# EasyEDA Pro project ProProject_IMUSensorNodes202312.epro, board 6_6_拼板20240123（不带编号） (continued)
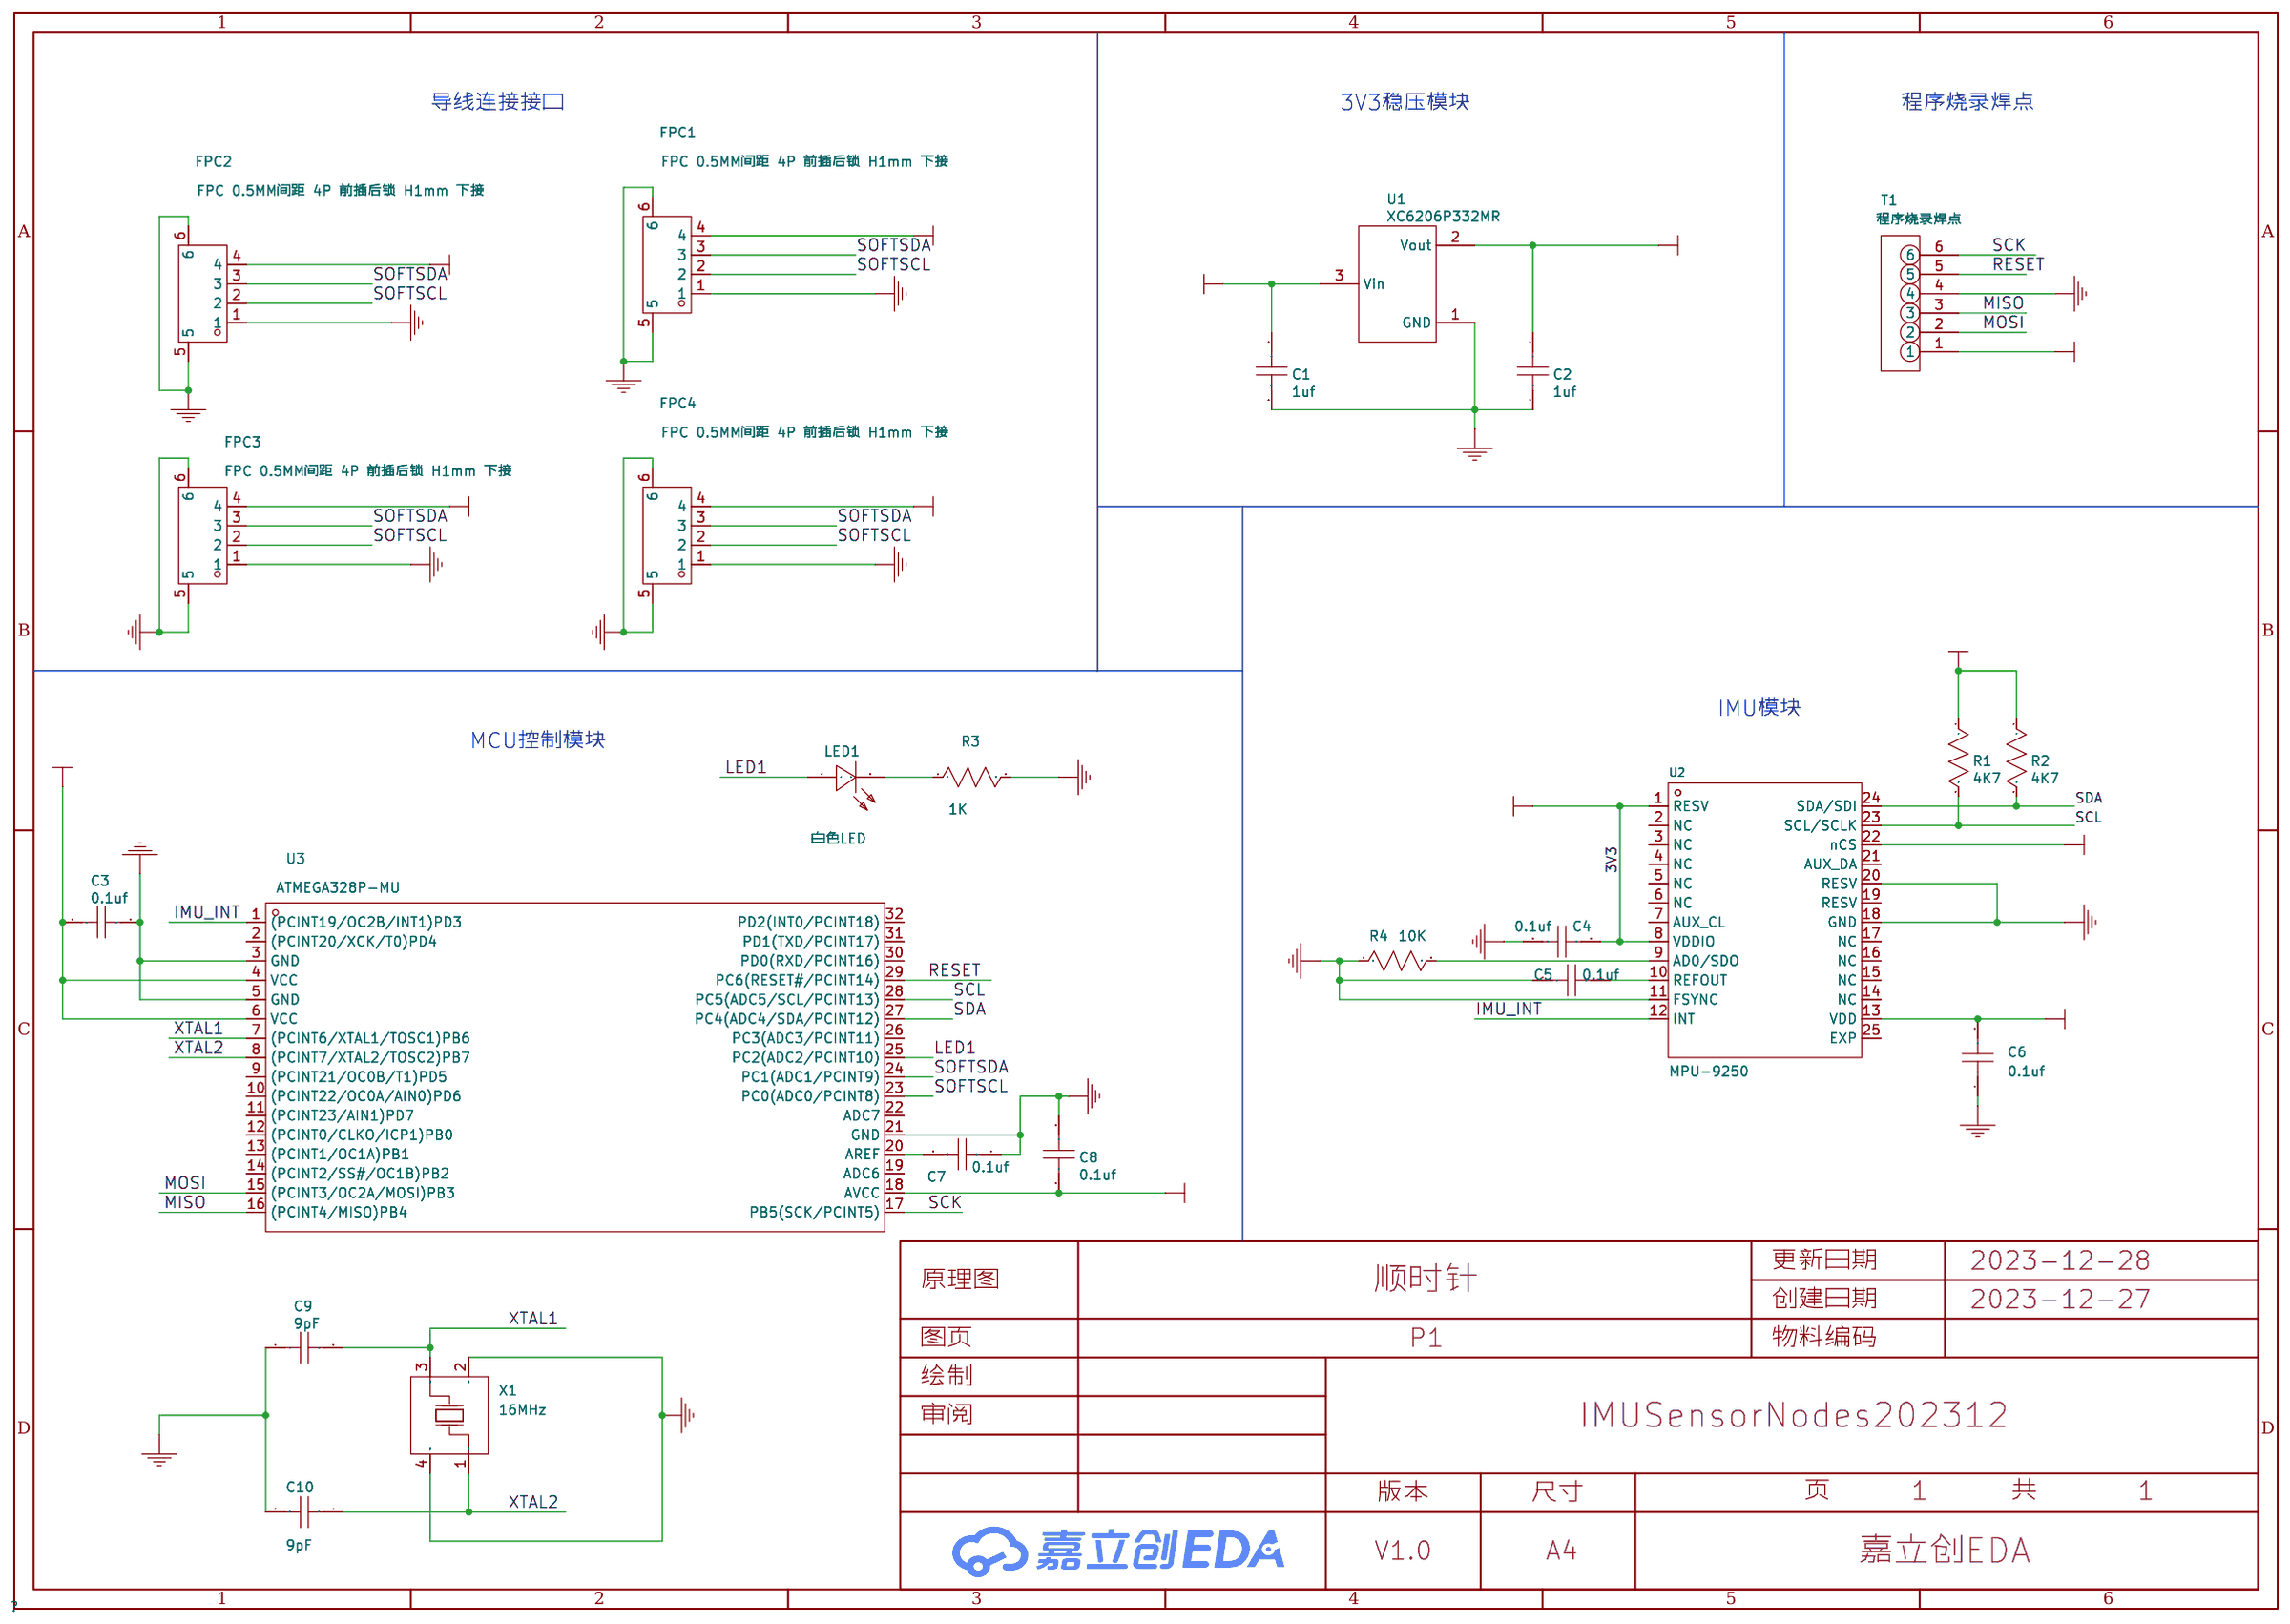
[diagram p0: schematic sheet]
## Nets (continued)
3V3: C2.1 C2#2.1 C2#3.1 C2#4.1 C2#5.1 C2#6.1 C2#7.1 C2#8.1 C2#9.1 C2#10.1 C2#11.1 C2#12.1 C2#13.1 C2#14.1 C2#15.1 C2#16.1 C2#17.1 C2#18.1 C2#19.1 C2#20.1 C2#21.1 C2#22.1 C2#23.1 C2#24.1 C2#25.1 C2#26.1 C2#27.1 C2#28.1 C2#29.1 C2#30.1 C2#31.1 C2#32.1 C2#33.1 C2#34.1 C2#35.1 C2#36.1 C3.1 C3#2.1 C3#3.1 C3#4.1 C3#5.1 C3#6.1 C3#7.1 C3#8.1 C3#9.1 C3#10.1 C3#11.1 C3#12.1 C3#13.1 C3#14.1 C3#15.1 C3#16.1 C3#17.1 C3#18.1 C3#19.1 C3#20.1 C3#21.1 C3#22.1 C3#23.1 C3#24.1 C3#25.1 C3#26.1 C3#27.1 C3#28.1 C3#29.1 C3#30.1 C3#31.1 C3#32.1 C3#33.1 C3#34.1 C3#35.1 C3#36.1 C4.1 C4#2.1 C4#3.1 C4#4.1 C4#5.1 C4#6.1 C4#7.1 C4#8.1 C4#9.1 C4#10.1 C4#11.1 C4#12.1 C4#13.1 C4#14.1 C4#15.1 C4#16.1 C4#17.1 C4#18.1 C4#19.1 C4#20.1 C4#21.1 C4#22.1 C4#23.1 C4#24.1 C4#25.1 C4#26.1 C4#27.1 C4#28.1 C4#29.1 C4#30.1 C4#31.1 C4#32.1 C4#33.1 C4#34.1 C4#35.1 C4#36.1 C6.2 C6#2.2 C6#3.2 C6#4.2 C6#5.2 C6#6.2 C6#7.2 C6#8.2 C6#9.2 C6#10.2 C6#11.2 C6#12.2 C6#13.2 C6#14.2 C6#15.2 C6#16.2 C6#17.2 C6#18.2 C6#19.2 C6#20.2 C6#21.2 C6#22.2 C6#23.2 C6#24.2 C6#25.2 C6#26.2 C6#27.2 C6#28.2 C6#29.2 C6#30.2 C6#31.2 C6#32.2 C6#33.2 C6#34.2 C6#35.2 C6#36.2 C8.1 C8#2.1 C8#3.1 C8#4.1 C8#5.1 C8#6.1 C8#7.1 C8#8.1 C8#9.1 C8#10.1 C8#11.1 C8#12.1 C8#13.1 C8#14.1 C8#15.1 C8#16.1 C8#17.1 C8#18.1 C8#19.1 C8#20.1 C8#21.1 C8#22.1 C8#23.1 C8#24.1 C8#25.1 C8#26.1 C8#27.1 C8#28.1 C8#29.1 C8#30.1 C8#31.1 C8#32.1 C8#33.1 C8#34.1 C8#35.1 C8#36.1 R1.1 R1#2.1 R1#3.1 R1#4.1 R1#5.1 R1#6.1 R1#7.1 R1#8.1 R1#9.1 R1#10.1 R1#11.1 R1#12.1 R1#13.1 R1#14.1 R1#15.1 R1#16.1 R1#17.1 R1#18.1 R1#19.1 R1#20.1 R1#21.1 R1#22.1 R1#23.1 R1#24.1 R1#25.1 R1#26.1 R1#27.1 R1#28.1 R1#29.1 R1#30.1 R1#31.1 R1#32.1 R1#33.1 R1#34.1 R1#35.1 R1#36.1 R2.1 R2#2.1 R2#3.1 R2#4.1 R2#5.1 R2#6.1 R2#7.1 R2#8.1 R2#9.1 R2#10.1 R2#11.1 R2#12.1 R2#13.1 R2#14.1 R2#15.1 R2#16.1 R2#17.1 R2#18.1 R2#19.1 R2#20.1 R2#21.1 R2#22.1 R2#23.1 R2#24.1 R2#25.1 R2#26.1 R2#27.1 R2#28.1 R2#29.1 R2#30.1 R2#31.1 R2#32.1 R2#33.1 R2#34.1 R2#35.1 R2#36.1 U1.2 U1#2.2 U1#3.2 U1#4.2 U1#5.2 U1#6.2 U1#7.2 U1#8.2 U1#9.2 U1#10.2 U1#11.2 U1#12.2 U1#13.2 U1#14.2 U1#15.2 U1#16.2 U1#17.2 U1#18.2 U1#19.2 U1#20.2 U1#21.2 U1#22.2 U1#23.2 U1#24.2 U1#25.2 U1#26.2 U1#27.2 U1#28.2 U1#29.2 U1#30.2 U1#31.2 U1#32.2 U1#33.2 U1#34.2 U1#35.2 U1#36.2 U2.1 U2.8 U2.13 U2.22 U2#2.1 U2#2.8 U2#2.13 U2#2.22 U2#3.1 U2#3.8 U2#3.13 U2#3.22 U2#4.1 U2#4.8 U2#4.13 U2#4.22 U2#5.1 U2#5.8 U2#5.13 U2#5.22 U2#6.1 U2#6.8 U2#6.13 U2#6.22 U2#7.1 U2#7.8 U2#7.13 U2#7.22 U2#8.1 U2#8.8 U2#8.13 U2#8.22 U2#9.1 U2#9.8 U2#9.13 U2#9.22 U2#10.1 U2#10.8 U2#10.13 U2#10.22 U2#11.1 U2#11.8 U2#11.13 U2#11.22 U2#12.1 U2#12.8 U2#12.13 U2#12.22 U2#13.1 U2#13.8 U2#13.13 U2#13.22 U2#14.1 U2#14.8 U2#14.13 U2#14.22 U2#15.1 U2#15.8 U2#15.13 U2#15.22 U2#16.1 U2#16.8 U2#16.13 U2#16.22 U2#17.1 U2#17.8 U2#17.13 U2#17.22 U2#18.1 U2#18.8 U2#18.13 U2#18.22 U2#19.1 U2#19.8 U2#19.13 U2#19.22 U2#20.1 U2#20.8 U2#20.13 U2#20.22 U2#21.1 U2#21.8 U2#21.13 U2#21.22 U2#22.1 U2#22.8 U2#22.13 U2#22.22 U2#23.1 U2#23.8 U2#23.13 U2#23.22 U2#24.1 U2#24.8 U2#24.13 U2#24.22 U2#25.1 U2#25.8 U2#25.13 U2#25.22 U2#26.1 U2#26.8 U2#26.13 U2#26.22 U2#27.1 U2#27.8 U2#27.13 U2#27.22 U2#28.1 U2#28.8 U2#28.13 U2#28.22 U2#29.1 U2#29.8 U2#29.13 U2#29.22 U2#30.1 U2#30.8 U2#30.13 U2#30.22 U2#31.1 U2#31.8 U2#31.13 U2#31.22 U2#32.1 U2#32.8 U2#32.13 U2#32.22 U2#33.1 U2#33.8 U2#33.13 U2#33.22 U2#34.1 U2#34.8 U2#34.13 U2#34.22 U2#35.1 U2#35.8 U2#35.13 U2#35.22 U2#36.1 U2#36.8 U2#36.13 U2#36.22 U3#61.4 U3#61.6 U3#61.18 U3#62.4 U3#62.6 U3#62.18 U3#63.4 U3#63.6 U3#63.18 U3#64.4 U3#64.6 U3#64.18 U3#65.4 U3#65.6 U3#65.18 U3#66.4 U3#66.6 U3#66.18 U3#67.4 U3#67.6 U3#67.18 U3#68.4 U3#68.6 U3#68.18 U3#69.4 U3#69.6 U3#69.18 U3#70.4 U3#70.6 U3#70.18 U3#71.4 U3#71.6 U3#71.18 U3#72.4 U3#72.6 U3#72.18 U3#73.4 U3#73.6 U3#73.18 U3#74.4 U3#74.6 U3#74.18 U3#75.4 U3#75.6 U3#75.18 U3#76.4 U3#76.6 U3#76.18 U3#77.4 U3#77.6 U3#77.18 U3#78.4 U3#78.6 U3#78.18 U3#79.4 U3#79.6 U3#79.18 U3#80.4 U3#80.6 U3#80.18 U3#81.4 U3#81.6 U3#81.18 U3#82.4 U3#82.6 U3#82.18 U3#83.4 U3#83.6 U3#83.18 U3#84.4 U3#84.6 U3#84.18 U3#85.4 U3#85.6 U3#85.18 U3#86.4 U3#86.6 U3#86.18 U3#87.4 U3#87.6 U3#87.18 U3#88.4 U3#88.6 U3#88.18 U3#89.4 U3#89.6 U3#89.18 U3#90.4 U3#90.6 U3#90.18 U3#91.4 U3#91.6 U3#91.18 U3#92.4 U3#92.6 U3#92.18 U3#93.4 U3#93.6 U3#93.18 U3#94.4 U3#94.6 U3#94.18 U3#95.4 U3#95.6 U3#95.18 U3#96.4 U3#96.6 U3#96.18
5V: C1.1 C1#2.1 C1#3.1 C1#4.1 C1#5.1 C1#6.1 C1#7.1 C1#8.1 C1#9.1 C1#10.1 C1#11.1 C1#12.1 C1#13.1 C1#14.1 C1#15.1 C1#16.1 C1#17.1 C1#18.1 C1#19.1 C1#20.1 C1#21.1 C1#22.1 C1#23.1 C1#24.1 C1#25.1 C1#26.1 C1#27.1 C1#28.1 C1#29.1 C1#30.1 C1#31.1 C1#32.1 C1#33.1 C1#34.1 C1#35.1 C1#36.1 FPC1.1 FPC1#2.1 FPC1#3.4 FPC1#4.1 FPC1#5.1 FPC1#6.1 FPC1#7.4 FPC1#8.1 FPC1#9.4 FPC1#10.4 FPC1#11.4 FPC1#12.1 FPC1#13.1 FPC1#14.1 FPC1#15.4 FPC1#16.4 FPC1#17.1 FPC1#18.1 FPC1#19.4 FPC1#20.4 FPC1#21.1 FPC1#22.4 FPC1#23.4 FPC1#24.1 FPC1#25.4 FPC1#26.4 FPC1#27.4 FPC1#28.1 FPC1#29.4 FPC1#30.4 FPC1#31.1 FPC1#32.1 FPC1#33.4 FPC1#34.1 FPC1#35.4 FPC1#36.1 FPC2.4 FPC2#2.4 FPC2#3.4 FPC2#4.1 FPC2#5.4 FPC2#6.1 FPC2#7.1 FPC2#8.1 FPC2#9.1 FPC2#10.1 FPC2#11.1 FPC2#12.1 FPC2#13.1 FPC2#14.4 FPC2#15.4 FPC2#16.4 FPC2#17.4 FPC2#18.4 FPC2#19.1 FPC2#20.4 FPC2#21.1 FPC2#22.4 FPC2#23.1 FPC2#24.4 FPC2#25.1 FPC2#26.4 FPC2#27.4 FPC2#28.4 FPC2#29.4 FPC2#30.4 FPC2#31.4 FPC2#32.1 FPC2#33.1 FPC2#34.1 FPC2#35.1 FPC2#36.1 FPC3.1 FPC3#2.4 FPC3#3.4 FPC3#4.4 FPC3#5.1 FPC3#6.1 FPC3#7.4 FPC3#8.1 FPC3#9.4 FPC3#10.1 FPC3#11.4 FPC3#12.1 FPC3#13.1 FPC3#14.1 FPC3#15.1 FPC3#16.4 FPC3#17.1 FPC3#18.4 FPC3#19.4 FPC3#20.1 FPC3#21.4 FPC3#22.4 FPC3#23.4 FPC3#24.4 FPC3#25.1 FPC3#26.1 FPC3#27.1 FPC3#28.4 FPC3#29.4 FPC3#30.1 FPC3#31.1 FPC3#32.1 FPC3#33.4 FPC3#34.4 FPC3#35.4 FPC3#36.1 FPC4.1 FPC4#2.4 FPC4#3.1 FPC4#4.4 FPC4#5.4 FPC4#6.1 FPC4#7.1 FPC4#8.1 FPC4#9.4 FPC4#10.4 FPC4#11.1 FPC4#12.1 FPC4#13.1 FPC4#14.4 FPC4#15.4 FPC4#16.4 FPC4#17.1 FPC4#18.1 FPC4#19.1 FPC4#20.4 FPC4#21.4 FPC4#22.4 FPC4#23.1 FPC4#24.4 FPC4#25.1 FPC4#26.4 FPC4#27.1 FPC4#28.4 FPC4#29.4 FPC4#30.1 FPC4#31.4 FPC4#32.4 FPC4#33.1 FPC4#34.4 FPC4#35.1 FPC4#36.1 T1.1 T1#2.1 T1#3.1 T1#4.1 T1#5.1 T1#6.1 T1#7.1 T1#8.1 T1#9.1 T1#10.1 T1#11.1 T1#12.1 T1#13.1 T1#14.1 T1#15.1 T1#16.1 T1#17.1 T1#18.1 T1#19.1 T1#20.1 T1#21.1 T1#22.1 T1#23.1 T1#24.1 T1#25.1 T1#26.1 T1#27.1 T1#28.1 T1#29.1 T1#30.1 T1#31.1 T1#32.1 T1#33.1 T1#34.1 T1#35.1 T1#36.1 U1.3 U1#2.3 U1#3.3 U1#4.3 U1#5.3 U1#6.3 U1#7.3 U1#8.3 U1#9.3 U1#10.3 U1#11.3 U1#12.3 U1#13.3 U1#14.3 U1#15.3 U1#16.3 U1#17.3 U1#18.3 U1#19.3 U1#20.3 U1#21.3 U1#22.3 U1#23.3 U1#24.3 U1#25.3 U1#26.3 U1#27.3 U1#28.3 U1#29.3 U1#30.3 U1#31.3 U1#32.3 U1#33.3 U1#34.3 U1#35.3 U1#36.3
GND: C1.2 C1#2.2 C1#3.2 C1#4.2 C1#5.2 C1#6.2 C1#7.2 C1#8.2 C1#9.2 C1#10.2 C1#11.2 C1#12.2 C1#13.2 C1#14.2 C1#15.2 C1#16.2 C1#17.2 C1#18.2 C1#19.2 C1#20.2 C1#21.2 C1#22.2 C1#23.2 C1#24.2 C1#25.2 C1#26.2 C1#27.2 C1#28.2 C1#29.2 C1#30.2 C1#31.2 C1#32.2 C1#33.2 C1#34.2 C1#35.2 C1#36.2 C2.2 C2#2.2 C2#3.2 C2#4.2 C2#5.2 C2#6.2 C2#7.2 C2#8.2 C2#9.2 C2#10.2 C2#11.2 C2#12.2 C2#13.2 C2#14.2 C2#15.2 C2#16.2 C2#17.2 C2#18.2 C2#19.2 C2#20.2 C2#21.2 C2#22.2 C2#23.2 C2#24.2 C2#25.2 C2#26.2 C2#27.2 C2#28.2 C2#29.2 C2#30.2 C2#31.2 C2#32.2 C2#33.2 C2#34.2 C2#35.2 C2#36.2 C3.2 C3#2.2 C3#3.2 C3#4.2 C3#5.2 C3#6.2 C3#7.2 C3#8.2 C3#9.2 C3#10.2 C3#11.2 C3#12.2 C3#13.2 C3#14.2 C3#15.2 C3#16.2 C3#17.2 C3#18.2 C3#19.2 C3#20.2 C3#21.2 C3#22.2 C3#23.2 C3#24.2 C3#25.2 C3#26.2 C3#27.2 C3#28.2 C3#29.2 C3#30.2 C3#31.2 C3#32.2 C3#33.2 C3#34.2 C3#35.2 C3#36.2 C4.2 C4#2.2 C4#3.2 C4#4.2 C4#5.2 C4#6.2 C4#7.2 C4#8.2 C4#9.2 C4#10.2 C4#11.2 C4#12.2 C4#13.2 C4#14.2 C4#15.2 C4#16.2 C4#17.2 C4#18.2 C4#19.2 C4#20.2 C4#21.2 C4#22.2 C4#23.2 C4#24.2 C4#25.2 C4#26.2 C4#27.2 C4#28.2 C4#29.2 C4#30.2 C4#31.2 C4#32.2 C4#33.2 C4#34.2 C4#35.2 C4#36.2 C5.1 C5#2.1 C5#3.1 C5#4.1 C5#5.1 C5#6.1 C5#7.1 C5#8.1 C5#9.1 C5#10.1 C5#11.1 C5#12.1 C5#13.1 C5#14.1 C5#15.1 C5#16.1 C5#17.1 C5#18.1 C5#19.1 C5#20.1 C5#21.1 C5#22.1 C5#23.1 C5#24.1 C5#25.1 C5#26.1 C5#27.1 C5#28.1 C5#29.1 C5#30.1 C5#31.1 C5#32.1 C5#33.1 C5#34.1 C5#35.1 C5#36.1 C6.1 C6#2.1 C6#3.1 C6#4.1 C6#5.1 C6#6.1 C6#7.1 C6#8.1 C6#9.1 C6#10.1 C6#11.1 C6#12.1 C6#13.1 C6#14.1 C6#15.1 C6#16.1 C6#17.1 C6#18.1 C6#19.1 C6#20.1 C6#21.1 C6#22.1 C6#23.1 C6#24.1 C6#25.1 C6#26.1 C6#27.1 C6#28.1 C6#29.1 C6#30.1 C6#31.1 C6#32.1 C6#33.1 C6#34.1 C6#35.1 C6#36.1 C7.1 C7#2.1 C7#3.1 C7#4.1 C7#5.1 C7#6.1 C7#7.1 C7#8.1 C7#9.1 C7#10.1 C7#11.1 C7#12.1 C7#13.1 C7#14.1 C7#15.1 C7#16.1 C7#17.1 C7#18.1 C7#19.1 C7#20.1 C7#21.1 C7#22.1 C7#23.1 C7#24.1 C7#25.1 C7#26.1 C7#27.1 C7#28.1 C7#29.1 C7#30.1 C7#31.1 C7#32.1 C7#33.1 C7#34.1 C7#35.1 C7#36.1 C8.2 C8#2.2 C8#3.2 C8#4.2 C8#5.2 C8#6.2 C8#7.2 C8#8.2 C8#9.2 C8#10.2 C8#11.2 C8#12.2 C8#13.2 C8#14.2 C8#15.2 C8#16.2 C8#17.2 C8#18.2 C8#19.2 C8#20.2 C8#21.2 C8#22.2 C8#23.2 C8#24.2 C8#25.2 C8#26.2 C8#27.2 C8#28.2 C8#29.2 C8#30.2 C8#31.2 C8#32.2 C8#33.2 C8#34.2 C8#35.2 C8#36.2 C9.1 C9#2.1 C9#3.1 C9#4.1 C9#5.1 C9#6.1 C9#7.1 C9#8.1 C9#9.1 C9#10.1 C9#11.1 C9#12.1 C9#13.1 C9#14.1 C9#15.1 C9#16.1 C9#17.1 C9#18.1 C9#19.1 C9#20.1 C9#21.1 C9#22.1 C9#23.1 C9#24.1 C9#25.1 C9#26.1 C9#27.1 C9#28.1 C9#29.1 C9#30.1 C9#31.1 C9#32.1 C9#33.1 C9#34.1 C9#35.1 C9#36.1 C10.2 C10#2.2 C10#3.2 C10#4.2 C10#5.2 C10#6.2 C10#7.2 C10#8.2 C10#9.2 C10#10.2 C10#11.2 C10#12.2 C10#13.2 C10#14.2 C10#15.2 C10#16.2 C10#17.2 C10#18.2 C10#19.2 C10#20.2 C10#21.2 C10#22.2 C10#23.2 C10#24.2 C10#25.2 C10#26.2 C10#27.2 C10#28.2 C10#29.2 C10#30.2 C10#31.2 C10#32.2 C10#33.2 C10#34.2 C10#35.2 C10#36.2 FPC1.4 FPC1.5 FPC1.6 FPC1#2.4 FPC1#2.5 FPC1#2.6 FPC1#3.1 FPC1#3.5 FPC1#3.6 FPC1#4.4 FPC1#4.5 FPC1#4.6 FPC1#5.4 FPC1#5.5 FPC1#5.6 FPC1#6.4 FPC1#6.5 FPC1#6.6 FPC1#7.1 FPC1#7.5 FPC1#7.6 FPC1#8.4 FPC1#8.5 FPC1#8.6 FPC1#9.1 FPC1#9.5 FPC1#9.6 FPC1#10.1 FPC1#10.5 FPC1#10.6 FPC1#11.1 FPC1#11.5 FPC1#11.6 FPC1#12.4 FPC1#12.5 FPC1#12.6 FPC1#13.4 FPC1#13.5 FPC1#13.6 FPC1#14.4 FPC1#14.5 FPC1#14.6 FPC1#15.1 FPC1#15.5 FPC1#15.6 FPC1#16.1 FPC1#16.5 FPC1#16.6 FPC1#17.4 FPC1#17.5 FPC1#17.6 FPC1#18.4 FPC1#18.5 FPC1#18.6 FPC1#19.1 FPC1#19.5 FPC1#19.6 FPC1#20.1 FPC1#20.5 FPC1#20.6 FPC1#21.4 FPC1#21.5 FPC1#21.6 FPC1#22.1 FPC1#22.5 FPC1#22.6 FPC1#23.1 FPC1#23.5 FPC1#23.6 FPC1#24.4 FPC1#24.5 FPC1#24.6 FPC1#25.1 FPC1#25.5 FPC1#25.6 FPC1#26.1 FPC1#26.5 FPC1#26.6 FPC1#27.1 FPC1#27.5 FPC1#27.6 FPC1#28.4 FPC1#28.5 FPC1#28.6 FPC1#29.1 FPC1#29.5 FPC1#29.6 FPC1#30.1 FPC1#30.5 FPC1#30.6 FPC1#31.4 FPC1#31.5 FPC1#31.6 FPC1#32.4 FPC1#32.5 FPC1#32.6 FPC1#33.1 FPC1#33.5 FPC1#33.6 FPC1#34.4 FPC1#34.5 FPC1#34.6 FPC1#35.1 FPC1#35.5 FPC1#35.6 FPC1#36.4 FPC1#36.5 FPC1#36.6 FPC2.1 FPC2.5 FPC2.6 FPC2#2.1 FPC2#2.5 FPC2#2.6 FPC2#3.1 FPC2#3.5 FPC2#3.6 FPC2#4.4 FPC2#4.5 FPC2#4.6 FPC2#5.1 FPC2#5.5 FPC2#5.6 FPC2#6.4 FPC2#6.5 FPC2#6.6 FPC2#7.4 FPC2#7.5 FPC2#7.6 FPC2#8.4 FPC2#8.5 FPC2#8.6 FPC2#9.4 FPC2#9.5 FPC2#9.6 FPC2#10.4 FPC2#10.5 FPC2#10.6 FPC2#11.4 FPC2#11.5 FPC2#11.6 FPC2#12.4 FPC2#12.5 FPC2#12.6 FPC2#13.4 FPC2#13.5 FPC2#13.6 FPC2#14.1 FPC2#14.5 FPC2#14.6 FPC2#15.1 FPC2#15.5 FPC2#15.6 FPC2#16.1 FPC2#16.5 FPC2#16.6 FPC2#17.1 FPC2#17.5 FPC2#17.6 FPC2#18.1 FPC2#18.5 FPC2#18.6 FPC2#19.4 FPC2#19.5 FPC2#19.6 FPC2#20.1 FPC2#20.5 FPC2#20.6 FPC2#21.4 FPC2#21.5 FPC2#21.6 FPC2#22.1 FPC2#22.5 FPC2#22.6 FPC2#23.4 FPC2#23.5 FPC2#23.6 FPC2#24.1 FPC2#24.5 FPC2#24.6 FPC2#25.4 FPC2#25.5 FPC2#25.6 FPC2#26.1 FPC2#26.5 FPC2#26.6 FPC2#27.1 FPC2#27.5 FPC2#27.6 FPC2#28.1 FPC2#28.5 FPC2#28.6 FPC2#29.1 FPC2#29.5 FPC2#29.6 FPC2#30.1 FPC2#30.5 FPC2#30.6 FPC2#31.1 FPC2#31.5 FPC2#31.6 FPC2#32.4 FPC2#32.5 FPC2#32.6 FPC2#33.4 FPC2#33.5 FPC2#33.6 FPC2#34.4 FPC2#34.5 FPC2#34.6 FPC2#35.4 FPC2#35.5 FPC2#35.6 FPC2#36.4 FPC2#36.5 FPC2#36.6 FPC3.4 FPC3.5 FPC3.6 FPC3#2.1 FPC3#2.5 FPC3#2.6 FPC3#3.1 FPC3#3.5 FPC3#3.6 FPC3#4.1 FPC3#4.5 FPC3#4.6 FPC3#5.4 FPC3#5.5 FPC3#5.6 FPC3#6.4 FPC3#6.5 FPC3#6.6 FPC3#7.1 FPC3#7.5 FPC3#7.6 FPC3#8.4 FPC3#8.5 FPC3#8.6 FPC3#9.1 FPC3#9.5 FPC3#9.6 FPC3#10.4 FPC3#10.5 FPC3#10.6 FPC3#11.1 FPC3#11.5 FPC3#11.6 FPC3#12.4 FPC3#12.5 FPC3#12.6 FPC3#13.4 FPC3#13.5 FPC3#13.6 FPC3#14.4 FPC3#14.5 FPC3#14.6 FPC3#15.4 FPC3#15.5 FPC3#15.6 FPC3#16.1 FPC3#16.5 FPC3#16.6 FPC3#17.4 FPC3#17.5 FPC3#17.6 FPC3#18.1 FPC3#18.5 FPC3#18.6 FPC3#19.1 FPC3#19.5 FPC3#19.6 FPC3#20.4 FPC3#20.5 FPC3#20.6 FPC3#21.1 FPC3#21.5 FPC3#21.6 FPC3#22.1 FPC3#22.5 FPC3#22.6 FPC3#23.1 FPC3#23.5 FPC3#23.6 FPC3#24.1 FPC3#24.5 FPC3#24.6 FPC3#25.4 FPC3#25.5 FPC3#25.6 FPC3#26.4 FPC3#26.5 FPC3#26.6 FPC3#27.4 FPC3#27.5 FPC3#27.6 FPC3#28.1 FPC3#28.5 FPC3#28.6 FPC3#29.1 FPC3#29.5 FPC3#29.6 FPC3#30.4 FPC3#30.5 FPC3#30.6 FPC3#31.4 FPC3#31.5 FPC3#31.6 FPC3#32.4 FPC3#32.5 FPC3#32.6 FPC3#33.1 FPC3#33.5 FPC3#33.6 FPC3#34.1 FPC3#34.5 FPC3#34.6 FPC3#35.1 FPC3#35.5 FPC3#35.6 FPC3#36.4 FPC3#36.5 FPC3#36.6 FPC4.4 FPC4#2.1 FPC4#3.4 FPC4#4.1 FPC4#5.1 FPC4#6.4 FPC4#7.4 FPC4#8.4 FPC4#9.1 FPC4#10.1 FPC4#11.4 FPC4#12.4 FPC4#13.4 FPC4#14.1 FPC4#15.1 FPC4#16.1 FPC4#17.4 FPC4#18.4 FPC4#19.4 FPC4#20.1 FPC4#21.1 FPC4#22.1 FPC4#23.4 FPC4#24.1 FPC4#25.4 FPC4#26.1 FPC4#27.4 FPC4#28.1 FPC4#29.1 FPC4#30.4 FPC4#31.1 FPC4#32.1 FPC4#33.4 FPC4#34.1 FPC4#35.4 FPC4#36.4 R3.2 R3#2.2 R3#3.2 R3#4.2 R3#5.2 R3#6.2 R3#7.2 R3#8.2 R3#9.2 R3#10.2 R3#11.2 R3#12.2 R3#13.2 R3#14.2 R3#15.2 R3#16.2 R3#17.2 R3#18.2 R3#19.2 R3#20.2 R3#21.2 R3#22.2 R3#23.2 R3#24.2 R3#25.2 R3#26.2 R3#27.2 R3#28.2 R3#29.2 R3#30.2 R3#31.2 R3#32.2 R3#33.2 R3#34.2 R3#35.2 R3#36.2 R4.1 R4#2.1 R4#3.1 R4#4.1 R4#5.1 R4#6.1 R4#7.1 R4#8.1 R4#9.1 R4#10.1 R4#11.1 R4#12.1 R4#13.1 R4#14.1 R4#15.1 R4#16.1 R4#17.1 R4#18.1 R4#19.1 R4#20.1 R4#21.1 R4#22.1 R4#23.1 R4#24.1 R4#25.1 R4#26.1 R4#27.1 R4#28.1 R4#29.1 R4#30.1 R4#31.1 R4#32.1 R4#33.1 R4#34.1 R4#35.1 R4#36.1 T1.4 T1#2.4 T1#3.4 T1#4.4 T1#5.4 T1#6.4 T1#7.4 T1#8.4 T1#9.4 T1#10.4 T1#11.4 T1#12.4 T1#13.4 T1#14.4 T1#15.4 T1#16.4 T1#17.4 T1#18.4 T1#19.4 T1#20.4 T1#21.4 T1#22.4 T1#23.4 T1#24.4 T1#25.4 T1#26.4 T1#27.4 T1#28.4 T1#29.4 T1#30.4 T1#31.4 T1#32.4 T1#33.4 T1#34.4 T1#35.4 T1#36.4 U1.1 U1#2.1 U1#3.1 U1#4.1 U1#5.1 U1#6.1 U1#7.1 U1#8.1 U1#9.1 U1#10.1 U1#11.1 U1#12.1 U1#13.1 U1#14.1 U1#15.1 U1#16.1 U1#17.1 U1#18.1 U1#19.1 U1#20.1 U1#21.1 U1#22.1 U1#23.1 U1#24.1 U1#25.1 U1#26.1 U1#27.1 U1#28.1 U1#29.1 U1#30.1 U1#31.1 U1#32.1 U1#33.1 U1#34.1 U1#35.1 U1#36.1 U2.11 U2.18 U2.20 U2.25 U2#2.11 U2#2.18 U2#2.20 U2#2.25 U2#3.11 U2#3.18 U2#3.20 U2#3.25 U2#4.11 U2#4.18 U2#4.20 U2#4.25 U2#5.11 U2#5.18 U2#5.20 U2#5.25 U2#6.11 U2#6.18 U2#6.20 U2#6.25 U2#7.11 U2#7.18 U2#7.20 U2#7.25 U2#8.11 U2#8.18 U2#8.20 U2#8.25 U2#9.11 U2#9.18 U2#9.20 U2#9.25 U2#10.11 U2#10.18 U2#10.20 U2#10.25 U2#11.11 U2#11.18 U2#11.20 U2#11.25 U2#12.11 U2#12.18 U2#12.20 U2#12.25 U2#13.11 U2#13.18 U2#13.20 U2#13.25 U2#14.11 U2#14.18 U2#14.20 U2#14.25 U2#15.11 U2#15.18 U2#15.20 U2#15.25 U2#16.11 U2#16.18 U2#16.20 U2#16.25 U2#17.11 U2#17.18 U2#17.20 U2#17.25 U2#18.11 U2#18.18 U2#18.20 U2#18.25 U2#19.11 U2#19.18 U2#19.20 U2#19.25 U2#20.11 U2#20.18 U2#20.20 U2#20.25 U2#21.11 U2#21.18 U2#21.20 U2#21.25 U2#22.11 U2#22.18 U2#22.20 U2#22.25 U2#23.11 U2#23.18 U2#23.20 U2#23.25 U2#24.11 U2#24.18 U2#24.20 U2#24.25 U2#25.11 U2#25.18 U2#25.20 U2#25.25 U2#26.11 U2#26.18 U2#26.20 U2#26.25 U2#27.11 U2#27.18 U2#27.20 U2#27.25 U2#28.11 U2#28.18 U2#28.20 U2#28.25 U2#29.11 U2#29.18 U2#29.20 U2#29.25 U2#30.11 U2#30.18 U2#30.20 U2#30.25 U2#31.11 U2#31.18 U2#31.20 U2#31.25 U2#32.11 U2#32.18 U2#32.20 U2#32.25 U2#33.11 U2#33.18 U2#33.20 U2#33.25 U2#34.11 U2#34.18 U2#34.20 U2#34.25 U2#35.11 U2#35.18 U2#35.20 U2#35.25 U2#36.11 U2#36.18 U2#36.20 U2#36.25 U3#61.3 U3#61.5 U3#61.21 U3#61.33 U3#62.3 U3#62.5 U3#62.21 U3#62.33 U3#63.3 U3#63.5 U3#63.21 U3#63.33 U3#64.3 U3#64.5 U3#64.21 U3#64.33 U3#65.3 U3#65.5 U3#65.21 U3#65.33 U3#66.3 U3#66.5 U3#66.21 U3#66.33 U3#67.3 U3#67.5 U3#67.21 U3#67.33 U3#68.3 U3#68.5 U3#68.21 U3#68.33 U3#69.3 U3#69.5 U3#69.21 U3#69.33 U3#70.3 U3#70.5 U3#70.21 U3#70.33 U3#71.3 U3#71.5 U3#71.21 U3#71.33 U3#72.3 U3#72.5 U3#72.21 U3#72.33 U3#73.3 U3#73.5 U3#73.21 U3#73.33 U3#74.3 U3#74.5 U3#74.21 U3#74.33 U3#75.3 U3#75.5 U3#75.21 U3#75.33 U3#76.3 U3#76.5 U3#76.21 U3#76.33 U3#77.3 U3#77.5 U3#77.21 U3#77.33 U3#78.3 U3#78.5 U3#78.21 U3#78.33 U3#79.3 U3#79.5 U3#79.21 U3#79.33 U3#80.3 U3#80.5 U3#80.21 U3#80.33 U3#81.3 U3#81.5 U3#81.21 U3#81.33 U3#82.3 U3#82.5 U3#82.21 U3#82.33 U3#83.3 U3#83.5 U3#83.21 U3#83.33 U3#84.3 U3#84.5 U3#84.21 U3#84.33 U3#85.3 U3#85.5 U3#85.21 U3#85.33 U3#86.3 U3#86.5 U3#86.21 U3#86.33 U3#87.3 U3#87.5 U3#87.21 U3#87.33 U3#88.3 U3#88.5 U3#88.21 U3#88.33 U3#89.3 U3#89.5 U3#89.21 U3#89.33 U3#90.3 U3#90.5 U3#90.21 U3#90.33 U3#91.3 U3#91.5 U3#91.21 U3#91.33 U3#92.3 U3#92.5 U3#92.21 U3#92.33 U3#93.3 U3#93.5 U3#93.21 U3#93.33 U3#94.3 U3#94.5 U3#94.21 U3#94.33 U3#95.3 U3#95.5 U3#95.21 U3#95.33 U3#96.3 U3#96.5 U3#96.21 U3#96.33 X1.2 X1.4 X1#2.2 X1#2.4 X1#3.2 X1#3.4 X1#4.2 X1#4.4 X1#5.2 X1#5.4 X1#6.2 X1#6.4 X1#7.2 X1#7.4 X1#8.2 X1#8.4 X1#9.2 X1#9.4 X1#10.2 X1#10.4 X1#11.2 X1#11.4 X1#12.2 X1#12.4 X1#13.2 X1#13.4 X1#14.2 X1#14.4 X1#15.2 X1#15.4 X1#16.2 X1#16.4 X1#17.2 X1#17.4 X1#18.2 X1#18.4 X1#19.2 X1#19.4 X1#20.2 X1#20.4 X1#21.2 X1#21.4 X1#22.2 X1#22.4 X1#23.2 X1#23.4 X1#24.2 X1#24.4 X1#25.2 X1#25.4 X1#26.2 X1#26.4 X1#27.2 X1#27.4 X1#28.2 X1#28.4 X1#29.2 X1#29.4 X1#30.2 X1#30.4 X1#31.2 X1#31.4 X1#32.2 X1#32.4 X1#33.2 X1#33.4 X1#34.2 X1#34.4 X1#35.2 X1#35.4 X1#36.2 X1#36.4
IMU_INT: U2.12 U2#2.12 U2#3.12 U2#4.12 U2#5.12 U2#6.12 U2#7.12 U2#8.12 U2#9.12 U2#10.12 U2#11.12 U2#12.12 U2#13.12 U2#14.12 U2#15.12 U2#16.12 U2#17.12 U2#18.12 U2#19.12 U2#20.12 U2#21.12 U2#22.12 U2#23.12 U2#24.12 U2#25.12 U2#26.12 U2#27.12 U2#28.12 U2#29.12 U2#30.12 U2#31.12 U2#32.12 U2#33.12 U2#34.12 U2#35.12 U2#36.12 U3#61.1 U3#62.1 U3#63.1 U3#64.1 U3#65.1 U3#66.1 U3#67.1 U3#68.1 U3#69.1 U3#70.1 U3#71.1 U3#72.1 U3#73.1 U3#74.1 U3#75.1 U3#76.1 U3#77.1 U3#78.1 U3#79.1 U3#80.1 U3#81.1 U3#82.1 U3#83.1 U3#84.1 U3#85.1 U3#86.1 U3#87.1 U3#88.1 U3#89.1 U3#90.1 U3#91.1 U3#92.1 U3#93.1 U3#94.1 U3#95.1 U3#96.1
LED1: LED1.1 LED1#2.1 LED1#3.1 LED1#4.1 LED1#5.1 LED1#6.1 LED1#7.1 LED1#8.1 LED1#9.1 LED1#10.1 LED1#11.1 LED1#12.1 LED1#13.1 LED1#14.1 LED1#15.1 LED1#16.1 LED1#17.1 LED1#18.1 LED1#19.1 LED1#20.1 LED1#21.1 LED1#22.1 LED1#23.1 LED1#24.1 LED1#25.1 LED1#26.1 LED1#27.1 LED1#28.1 LED1#29.1 LED1#30.1 LED1#31.1 LED1#32.1 LED1#33.1 LED1#34.1 LED1#35.1 LED1#36.1 U3#61.25 U3#62.25 U3#63.25 U3#64.25 U3#65.25 U3#66.25 U3#67.25 U3#68.25 U3#69.25 U3#70.25 U3#71.25 U3#72.25 U3#73.25 U3#74.25 U3#75.25 U3#76.25 U3#77.25 U3#78.25 U3#79.25 U3#80.25 U3#81.25 U3#82.25 U3#83.25 U3#84.25 U3#85.25 U3#86.25 U3#87.25 U3#88.25 U3#89.25 U3#90.25 U3#91.25 U3#92.25 U3#93.25 U3#94.25 U3#95.25 U3#96.25
MISO: T1.3 T1#2.3 T1#3.3 T1#4.3 T1#5.3 T1#6.3 T1#7.3 T1#8.3 T1#9.3 T1#10.3 T1#11.3 T1#12.3 T1#13.3 T1#14.3 T1#15.3 T1#16.3 T1#17.3 T1#18.3 T1#19.3 T1#20.3 T1#21.3 T1#22.3 T1#23.3 T1#24.3 T1#25.3 T1#26.3 T1#27.3 T1#28.3 T1#29.3 T1#30.3 T1#31.3 T1#32.3 T1#33.3 T1#34.3 T1#35.3 T1#36.3 U3#61.16 U3#62.16 U3#63.16 U3#64.16 U3#65.16 U3#66.16 U3#67.16 U3#68.16 U3#69.16 U3#70.16 U3#71.16 U3#72.16 U3#73.16 U3#74.16 U3#75.16 U3#76.16 U3#77.16 U3#78.16 U3#79.16 U3#80.16 U3#81.16 U3#82.16 U3#83.16 U3#84.16 U3#85.16 U3#86.16 U3#87.16 U3#88.16 U3#89.16 U3#90.16 U3#91.16 U3#92.16 U3#93.16 U3#94.16 U3#95.16 U3#96.16
MOSI: T1.2 T1#2.2 T1#3.2 T1#4.2 T1#5.2 T1#6.2 T1#7.2 T1#8.2 T1#9.2 T1#10.2 T1#11.2 T1#12.2 T1#13.2 T1#14.2 T1#15.2 T1#16.2 T1#17.2 T1#18.2 T1#19.2 T1#20.2 T1#21.2 T1#22.2 T1#23.2 T1#24.2 T1#25.2 T1#26.2 T1#27.2 T1#28.2 T1#29.2 T1#30.2 T1#31.2 T1#32.2 T1#33.2 T1#34.2 T1#35.2 T1#36.2 U3#61.15 U3#62.15 U3#63.15 U3#64.15 U3#65.15 U3#66.15 U3#67.15 U3#68.15 U3#69.15 U3#70.15 U3#71.15 U3#72.15 U3#73.15 U3#74.15 U3#75.15 U3#76.15 U3#77.15 U3#78.15 U3#79.15 U3#80.15 U3#81.15 U3#82.15 U3#83.15 U3#84.15 U3#85.15 U3#86.15 U3#87.15 U3#88.15 U3#89.15 U3#90.15 U3#91.15 U3#92.15 U3#93.15 U3#94.15 U3#95.15 U3#96.15
RESET: FPC4.5 FPC4.6 FPC4#2.5 FPC4#2.6 FPC4#3.5 FPC4#3.6 FPC4#4.5 FPC4#4.6 FPC4#5.5 FPC4#5.6 FPC4#6.5 FPC4#6.6 FPC4#7.5 FPC4#7.6 FPC4#8.5 FPC4#8.6 FPC4#9.5 FPC4#9.6 FPC4#10.5 FPC4#10.6 FPC4#11.5 FPC4#11.6 FPC4#12.5 FPC4#12.6 FPC4#13.5 FPC4#13.6 FPC4#14.5 FPC4#14.6 FPC4#15.5 FPC4#15.6 FPC4#16.5 FPC4#16.6 FPC4#17.5 FPC4#17.6 FPC4#18.5 FPC4#18.6 FPC4#19.5 FPC4#19.6 FPC4#20.5 FPC4#20.6 FPC4#21.5 FPC4#21.6 FPC4#22.5 FPC4#22.6 FPC4#23.5 FPC4#23.6 FPC4#24.5 FPC4#24.6 FPC4#25.5 FPC4#25.6 FPC4#26.5 FPC4#26.6 FPC4#27.5 FPC4#27.6 FPC4#28.5 FPC4#28.6 FPC4#29.5 FPC4#29.6 FPC4#30.5 FPC4#30.6 FPC4#31.5 FPC4#31.6 FPC4#32.5 FPC4#32.6 FPC4#33.5 FPC4#33.6 FPC4#34.5 FPC4#34.6 FPC4#35.5 FPC4#35.6 FPC4#36.5 FPC4#36.6 T1.5 T1#2.5 T1#3.5 T1#4.5 T1#5.5 T1#6.5 T1#7.5 T1#8.5 T1#9.5 T1#10.5 T1#11.5 T1#12.5 T1#13.5 T1#14.5 T1#15.5 T1#16.5 T1#17.5 T1#18.5 T1#19.5 T1#20.5 T1#21.5 T1#22.5 T1#23.5 T1#24.5 T1#25.5 T1#26.5 T1#27.5 T1#28.5 T1#29.5 T1#30.5 T1#31.5 T1#32.5 T1#33.5 T1#34.5 T1#35.5 T1#36.5 U3#61.29 U3#62.29 U3#63.29 U3#64.29 U3#65.29 U3#66.29 U3#67.29 U3#68.29 U3#69.29 U3#70.29 U3#71.29 U3#72.29 U3#73.29 U3#74.29 U3#75.29 U3#76.29 U3#77.29 U3#78.29 U3#79.29 U3#80.29 U3#81.29 U3#82.29 U3#83.29 U3#84.29 U3#85.29 U3#86.29 U3#87.29 U3#88.29 U3#89.29 U3#90.29 U3#91.29 U3#92.29 U3#93.29 U3#94.29 U3#95.29 U3#96.29
SCK: T1.6 T1#2.6 T1#3.6 T1#4.6 T1#5.6 T1#6.6 T1#7.6 T1#8.6 T1#9.6 T1#10.6 T1#11.6 T1#12.6 T1#13.6 T1#14.6 T1#15.6 T1#16.6 T1#17.6 T1#18.6 T1#19.6 T1#20.6 T1#21.6 T1#22.6 T1#23.6 T1#24.6 T1#25.6 T1#26.6 T1#27.6 T1#28.6 T1#29.6 T1#30.6 T1#31.6 T1#32.6 T1#33.6 T1#34.6 T1#35.6 T1#36.6 U3#61.17 U3#62.17 U3#63.17 U3#64.17 U3#65.17 U3#66.17 U3#67.17 U3#68.17 U3#69.17 U3#70.17 U3#71.17 U3#72.17 U3#73.17 U3#74.17 U3#75.17 U3#76.17 U3#77.17 U3#78.17 U3#79.17 U3#80.17 U3#81.17 U3#82.17 U3#83.17 U3#84.17 U3#85.17 U3#86.17 U3#87.17 U3#88.17 U3#89.17 U3#90.17 U3#91.17 U3#92.17 U3#93.17 U3#94.17 U3#95.17 U3#96.17
SCL: R1.2 R1#2.2 R1#3.2 R1#4.2 R1#5.2 R1#6.2 R1#7.2 R1#8.2 R1#9.2 R1#10.2 R1#11.2 R1#12.2 R1#13.2 R1#14.2 R1#15.2 R1#16.2 R1#17.2 R1#18.2 R1#19.2 R1#20.2 R1#21.2 R1#22.2 R1#23.2 R1#24.2 R1#25.2 R1#26.2 R1#27.2 R1#28.2 R1#29.2 R1#30.2 R1#31.2 R1#32.2 R1#33.2 R1#34.2 R1#35.2 R1#36.2 U2.23 U2#2.23 U2#3.23 U2#4.23 U2#5.23 U2#6.23 U2#7.23 U2#8.23 U2#9.23 U2#10.23 U2#11.23 U2#12.23 U2#13.23 U2#14.23 U2#15.23 U2#16.23 U2#17.23 U2#18.23 U2#19.23 U2#20.23 U2#21.23 U2#22.23 U2#23.23 U2#24.23 U2#25.23 U2#26.23 U2#27.23 U2#28.23 U2#29.23 U2#30.23 U2#31.23 U2#32.23 U2#33.23 U2#34.23 U2#35.23 U2#36.23 U3#61.28 U3#62.28 U3#63.28 U3#64.28 U3#65.28 U3#66.28 U3#67.28 U3#68.28 U3#69.28 U3#70.28 U3#71.28 U3#72.28 U3#73.28 U3#74.28 U3#75.28 U3#76.28 U3#77.28 U3#78.28 U3#79.28 U3#80.28 U3#81.28 U3#82.28 U3#83.28 U3#84.28 U3#85.28 U3#86.28 U3#87.28 U3#88.28 U3#89.28 U3#90.28 U3#91.28 U3#92.28 U3#93.28 U3#94.28 U3#95.28 U3#96.28
SDA: R2.2 R2#2.2 R2#3.2 R2#4.2 R2#5.2 R2#6.2 R2#7.2 R2#8.2 R2#9.2 R2#10.2 R2#11.2 R2#12.2 R2#13.2 R2#14.2 R2#15.2 R2#16.2 R2#17.2 R2#18.2 R2#19.2 R2#20.2 R2#21.2 R2#22.2 R2#23.2 R2#24.2 R2#25.2 R2#26.2 R2#27.2 R2#28.2 R2#29.2 R2#30.2 R2#31.2 R2#32.2 R2#33.2 R2#34.2 R2#35.2 R2#36.2 U2.24 U2#2.24 U2#3.24 U2#4.24 U2#5.24 U2#6.24 U2#7.24 U2#8.24 U2#9.24 U2#10.24 U2#11.24 U2#12.24 U2#13.24 U2#14.24 U2#15.24 U2#16.24 U2#17.24 U2#18.24 U2#19.24 U2#20.24 U2#21.24 U2#22.24 U2#23.24 U2#24.24 U2#25.24 U2#26.24 U2#27.24 U2#28.24 U2#29.24 U2#30.24 U2#31.24 U2#32.24 U2#33.24 U2#34.24 U2#35.24 U2#36.24 U3#61.27 U3#62.27 U3#63.27 U3#64.27 U3#65.27 U3#66.27 U3#67.27 U3#68.27 U3#69.27 U3#70.27 U3#71.27 U3#72.27 U3#73.27 U3#74.27 U3#75.27 U3#76.27 U3#77.27 U3#78.27 U3#79.27 U3#80.27 U3#81.27 U3#82.27 U3#83.27 U3#84.27 U3#85.27 U3#86.27 U3#87.27 U3#88.27 U3#89.27 U3#90.27 U3#91.27 U3#92.27 U3#93.27 U3#94.27 U3#95.27 U3#96.27